# Altium schematic sheet ZYNQ_US_SOC_PL_FPGA_Banks_63_64_65_DDR4.SchDoc
size 419 x 296 mm
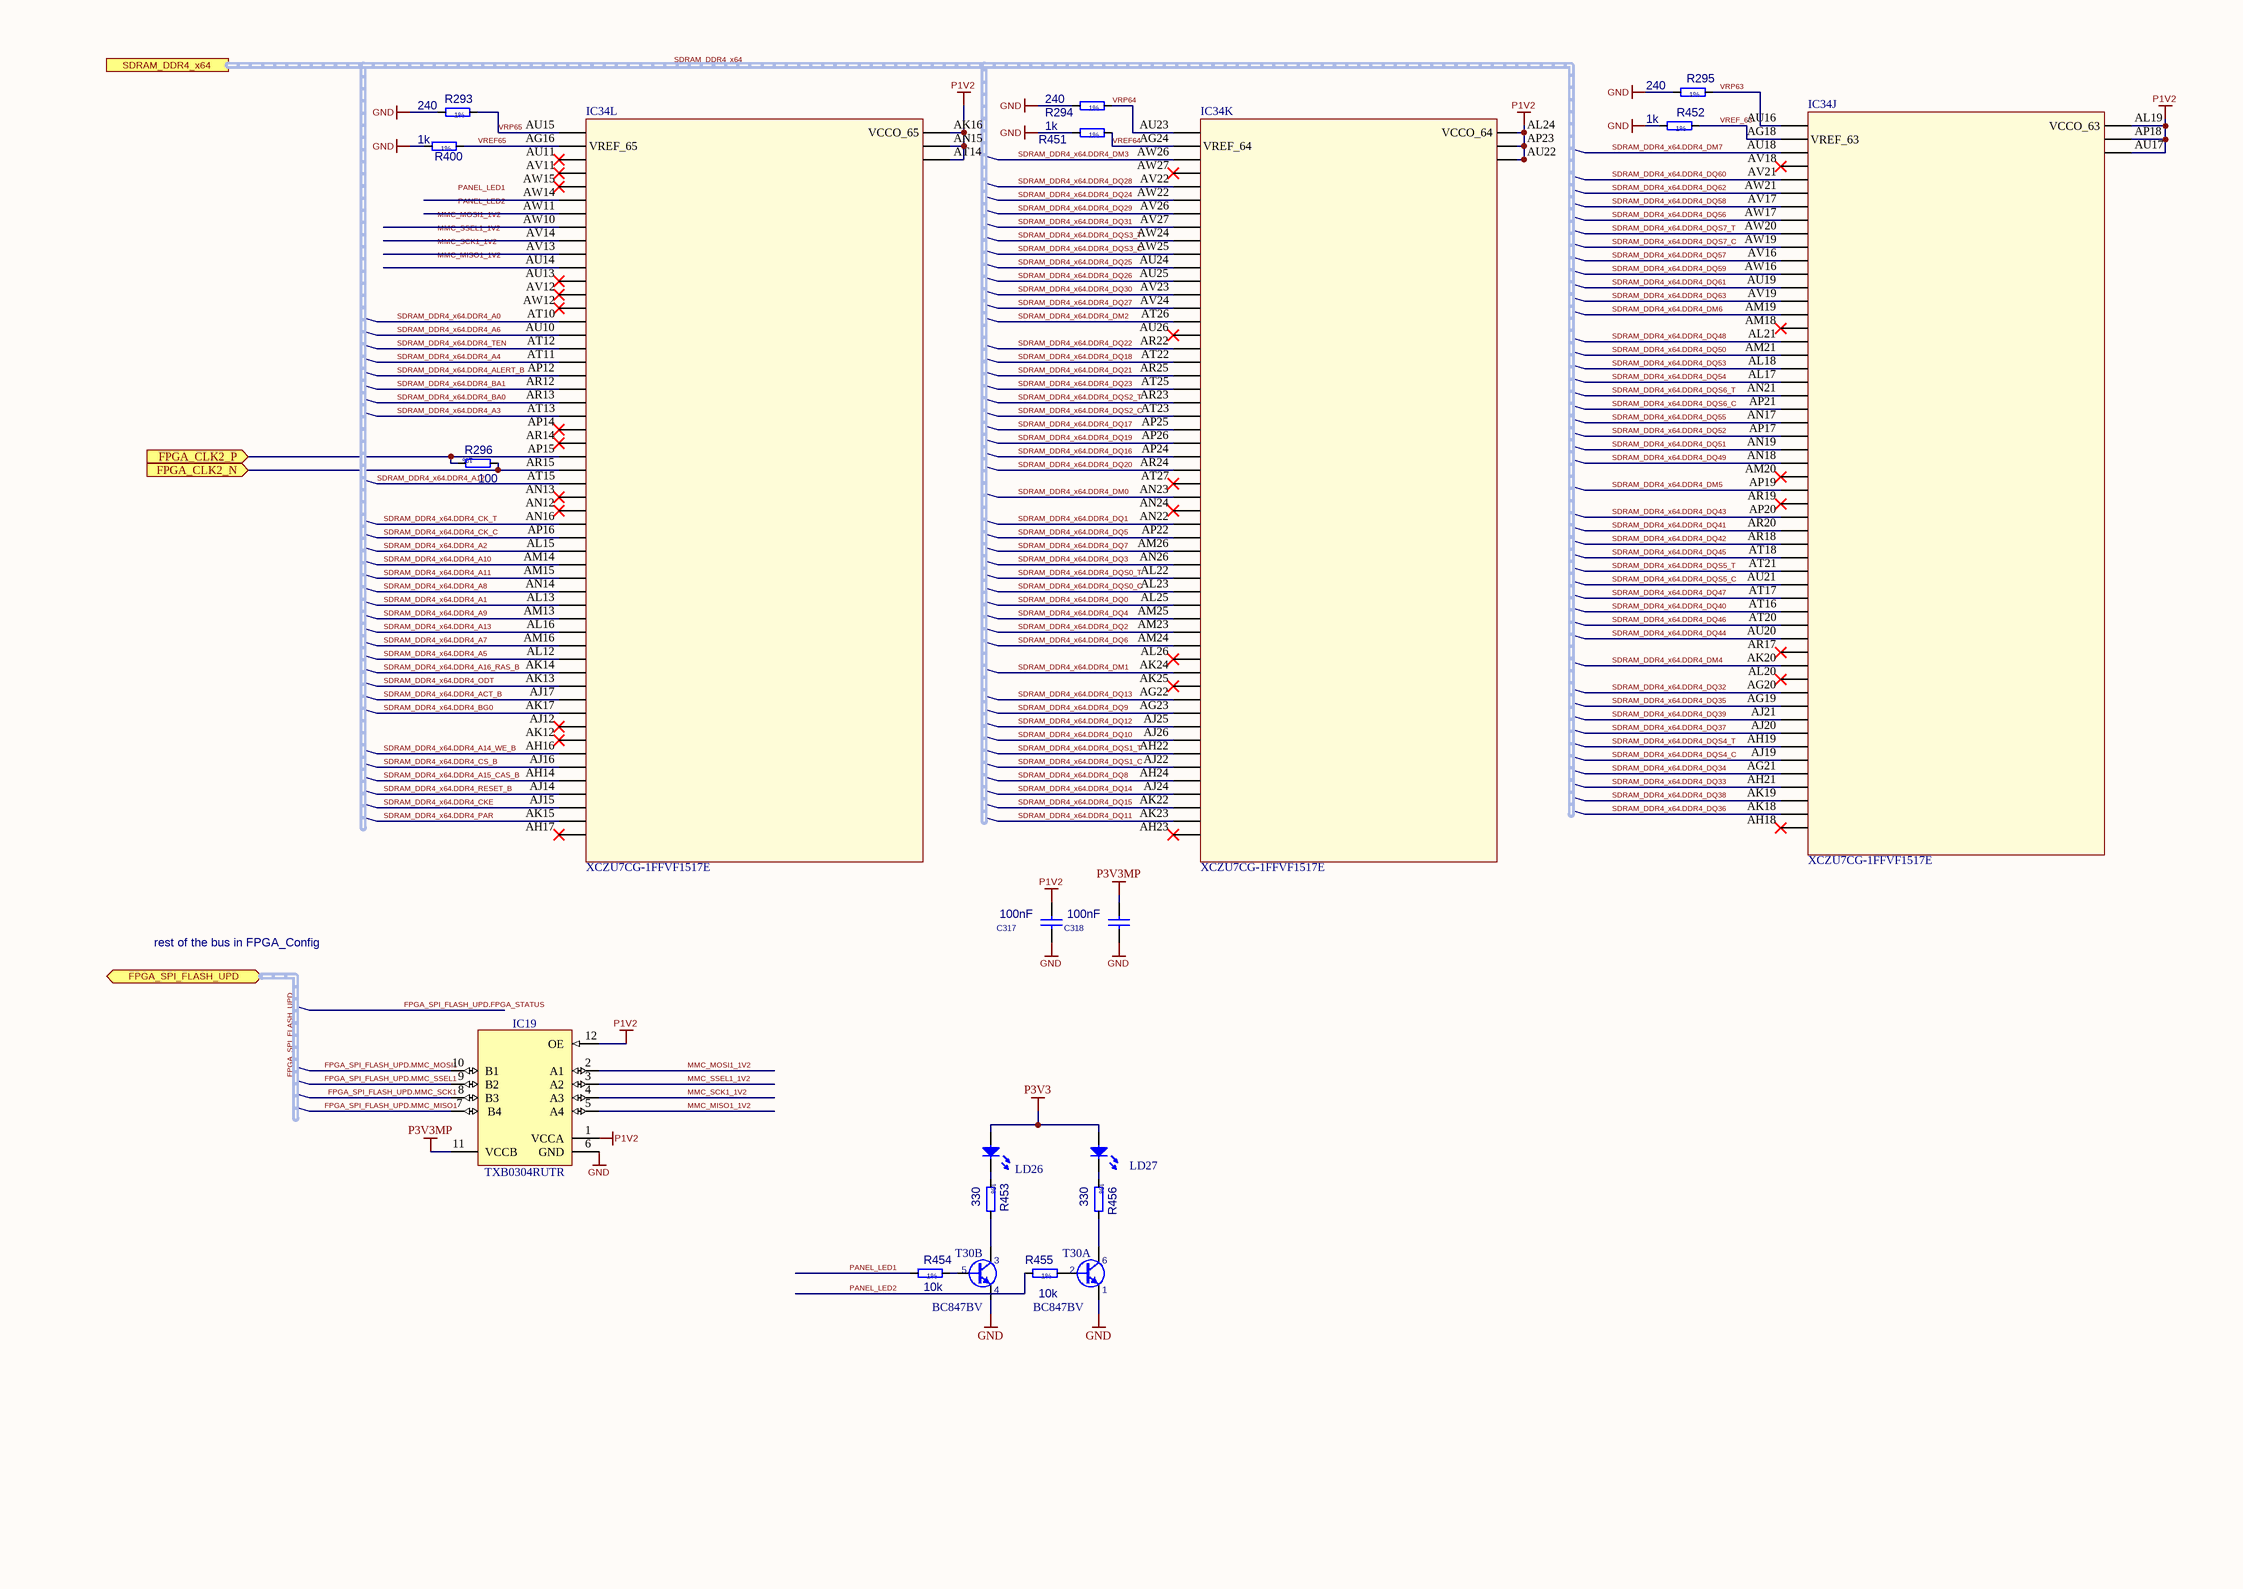
[diagram p0: ZYNQ_US_SOC_PL_FPGA_Banks_63_64_65_DDR4.SchDoc]

## Parts
C317  value 100nF  [CAPC0603X33N]  (hidden comment: Capacitor - non polarized CAPC0603X33N)
C318  value 100nF  [CAPC0603X33N]  (hidden comment: Capacitor - non polarized CAPC0603X33N)
IC19  TXB0304RUTR  [TEXAS_RUT (R-PUQFN-N12)]
IC34  XCZU7CG-1FFVF1517E  (parts J,K,L of 26)
LD26  Green  [LED_AVAGO_HSME-C120]  (value not drawn)
LD27  Green  [LED_AVAGO_HSME-C120]  (value not drawn)
R293  value 240  (hidden comment: Resistor - 1% RESC1005X40N)
R294  value 240  (hidden comment: Resistor - 1% RESC1005X40N)
R295  value 240  (hidden comment: Resistor - 1% RESC1005X40N)
R296  value 100  (hidden comment: Resistor - 1% RESC1005X40N)
R400  value 1k  (hidden comment: Resistor - 1% RESC1005X40N)
R451  value 1k  (hidden comment: Resistor - 1% RESC1005X40N)
R452  value 1k  (hidden comment: Resistor - 1% RESC1005X40N)
R453  value 330  (hidden comment: Resistor - 1% RESC1005X40N)
R454  value 10k  (hidden comment: Resistor - 1% RESC1005X40N)
R455  value 10k  (hidden comment: Resistor - 1% RESC1005X40N)
R456  value 330  (hidden comment: Resistor - 1% RESC1005X40N)
T30  BC847BV  [SOTFL50P160X60-6N]  (parts A,B of 2)

## Ports
FPGA_CLK2_N (in), FPGA_CLK2_P (in), FPGA_SPI_FLASH_UPD (bidir, harness FPGA_SPI_FLASH_UPD), SDRAM_DDR4_x64 (harness SDRAM_DDR4_x64)

## Nets
GND: C317.1 C318.1 IC19.6(GND) R293.1 R294.1 R295.1 R400.1 R451.1 R452.1 T30.1(E) T30.4(E)
P1V2: C317.2 IC19.1(VCCA) IC19.12(OE) IC34.AK16(VCCO_65) IC34.AL19(VCCO_63) IC34.AL24(VCCO_64) IC34.AN15(VCCO_65_1) IC34.AP18(VCCO_63_1) IC34.AP23(VCCO_64_1) IC34.AT14(VCCO_65_2) IC34.AU17(VCCO_63_2) IC34.AU22(VCCO_64_2)
P3V3: LD26.2(A) LD27.2(A)
P3V3MP: C318.2 IC19.11(VCCB)
FPGA_CLK2_N: IC34.AR15(IOB_X2Y128) R296.2 ; port FPGA_CLK2_N
FPGA_CLK2_P: IC34.AP15(IOB_X2Y127) R296.1 ; port FPGA_CLK2_P
FPGA_SPI_FLASH_UPD.MMC_MISO1: IC19.7(B4)
FPGA_SPI_FLASH_UPD.MMC_MOSI1: IC19.10(B1)
FPGA_SPI_FLASH_UPD.MMC_SCK1: IC19.8(B3)
FPGA_SPI_FLASH_UPD.MMC_SSEL1: IC19.9(B2)
MMC_MISO1_1V2: IC19.5(A4)
MMC_MOSI1_1V2: IC19.2(A1)
MMC_SCK1_1V2: IC19.4(A3)
MMC_SSEL1_1V2: IC19.3(A2)
PANEL_LED1: R454.1
PANEL_LED2: R455.1
SDRAM_DDR4_x64.DDR4_A0: IC34.AT10(IOB_X2Y117)
SDRAM_DDR4_x64.DDR4_A1: IC34.AL13(IOB_X2Y138)
SDRAM_DDR4_x64.DDR4_A2: IC34.AL15(IOB_X2Y134)
SDRAM_DDR4_x64.DDR4_A3: IC34.AT13(IOB_X2Y124)
SDRAM_DDR4_x64.DDR4_A4: IC34.AT11(IOB_X2Y120)
SDRAM_DDR4_x64.DDR4_A5: IC34.AL12(IOB_X2Y142)
SDRAM_DDR4_x64.DDR4_A6: IC34.AU10(IOB_X2Y118)
SDRAM_DDR4_x64.DDR4_A7: IC34.AM16(IOB_X2Y141)
SDRAM_DDR4_x64.DDR4_A8: IC34.AN14(IOB_X2Y137)
SDRAM_DDR4_x64.DDR4_A9: IC34.AM13(IOB_X2Y139)
SDRAM_DDR4_x64.DDR4_A10: IC34.AM14(IOB_X2Y135)
SDRAM_DDR4_x64.DDR4_A11: IC34.AM15(IOB_X2Y136)
SDRAM_DDR4_x64.DDR4_A12: IC34.AT15(IOB_X2Y129)
SDRAM_DDR4_x64.DDR4_A13: IC34.AL16(IOB_X2Y140)
SDRAM_DDR4_x64.DDR4_A14_WE_B: IC34.AH16(IOB_X2Y149)
SDRAM_DDR4_x64.DDR4_A15_CAS_B: IC34.AH14(IOB_X2Y151)
SDRAM_DDR4_x64.DDR4_A16_RAS_B: IC34.AK14(IOB_X2Y143)
SDRAM_DDR4_x64.DDR4_ACT_B: IC34.AJ17(IOB_X2Y145)
SDRAM_DDR4_x64.DDR4_ALERT_B: IC34.AP12(IOB_X2Y121)
SDRAM_DDR4_x64.DDR4_BA0: IC34.AR13(IOB_X2Y123)
SDRAM_DDR4_x64.DDR4_BA1: IC34.AR12(IOB_X2Y122)
SDRAM_DDR4_x64.DDR4_BG0: IC34.AK17(IOB_X2Y146)
SDRAM_DDR4_x64.DDR4_CK_C: IC34.AP16(IOB_X2Y133)
SDRAM_DDR4_x64.DDR4_CK_T: IC34.AN16(IOB_X2Y132)
SDRAM_DDR4_x64.DDR4_CKE: IC34.AJ15(IOB_X2Y153)
SDRAM_DDR4_x64.DDR4_CS_B: IC34.AJ16(IOB_X2Y150)
SDRAM_DDR4_x64.DDR4_DM0: IC34.AN23(IOB_X2Y78)
SDRAM_DDR4_x64.DDR4_DM1: IC34.AK24(IOB_X2Y91)
SDRAM_DDR4_x64.DDR4_DM2: IC34.AT26(IOB_X2Y65)
SDRAM_DDR4_x64.DDR4_DM3: IC34.AW26(IOB_X2Y52)
SDRAM_DDR4_x64.DDR4_DM4: IC34.AK20(IOB_X2Y39)
SDRAM_DDR4_x64.DDR4_DM5: IC34.AP19(IOB_X2Y26)
SDRAM_DDR4_x64.DDR4_DM6: IC34.AM19(IOB_X2Y13)
SDRAM_DDR4_x64.DDR4_DM7: IC34.AU18(IOB_X2Y0)
SDRAM_DDR4_x64.DDR4_DQ0: IC34.AL25(IOB_X2Y86)
SDRAM_DDR4_x64.DDR4_DQ1: IC34.AN22(IOB_X2Y80)
SDRAM_DDR4_x64.DDR4_DQ2: IC34.AM23(IOB_X2Y88)
SDRAM_DDR4_x64.DDR4_DQ3: IC34.AN26(IOB_X2Y83)
SDRAM_DDR4_x64.DDR4_DQ4: IC34.AM25(IOB_X2Y87)
SDRAM_DDR4_x64.DDR4_DQ5: IC34.AP22(IOB_X2Y81)
SDRAM_DDR4_x64.DDR4_DQ6: IC34.AM24(IOB_X2Y89)
SDRAM_DDR4_x64.DDR4_DQ7: IC34.AM26(IOB_X2Y82)
SDRAM_DDR4_x64.DDR4_DQ8: IC34.AH24(IOB_X2Y99)
SDRAM_DDR4_x64.DDR4_DQ9: IC34.AG23(IOB_X2Y94)
SDRAM_DDR4_x64.DDR4_DQ10: IC34.AJ26(IOB_X2Y96)
SDRAM_DDR4_x64.DDR4_DQ11: IC34.AK23(IOB_X2Y102)
SDRAM_DDR4_x64.DDR4_DQ12: IC34.AJ25(IOB_X2Y95)
SDRAM_DDR4_x64.DDR4_DQ13: IC34.AG22(IOB_X2Y93)
SDRAM_DDR4_x64.DDR4_DQ14: IC34.AJ24(IOB_X2Y100)
SDRAM_DDR4_x64.DDR4_DQ15: IC34.AK22(IOB_X2Y101)
SDRAM_DDR4_x64.DDR4_DQ16: IC34.AP24(IOB_X2Y75)
SDRAM_DDR4_x64.DDR4_DQ17: IC34.AP25(IOB_X2Y73)
SDRAM_DDR4_x64.DDR4_DQ18: IC34.AT22(IOB_X2Y68)
SDRAM_DDR4_x64.DDR4_DQ19: IC34.AP26(IOB_X2Y74)
SDRAM_DDR4_x64.DDR4_DQ20: IC34.AR24(IOB_X2Y76)
SDRAM_DDR4_x64.DDR4_DQ21: IC34.AR25(IOB_X2Y69)
SDRAM_DDR4_x64.DDR4_DQ22: IC34.AR22(IOB_X2Y67)
SDRAM_DDR4_x64.DDR4_DQ23: IC34.AT25(IOB_X2Y70)
SDRAM_DDR4_x64.DDR4_DQ24: IC34.AW22(IOB_X2Y55)
SDRAM_DDR4_x64.DDR4_DQ25: IC34.AU24(IOB_X2Y60)
SDRAM_DDR4_x64.DDR4_DQ26: IC34.AU25(IOB_X2Y61)
SDRAM_DDR4_x64.DDR4_DQ27: IC34.AV24(IOB_X2Y63)
SDRAM_DDR4_x64.DDR4_DQ28: IC34.AV22(IOB_X2Y54)
SDRAM_DDR4_x64.DDR4_DQ29: IC34.AV26(IOB_X2Y56)
SDRAM_DDR4_x64.DDR4_DQ30: IC34.AV23(IOB_X2Y62)
SDRAM_DDR4_x64.DDR4_DQ31: IC34.AV27(IOB_X2Y57)
SDRAM_DDR4_x64.DDR4_DQ32: IC34.AG20(IOB_X2Y41)
SDRAM_DDR4_x64.DDR4_DQ33: IC34.AH21(IOB_X2Y48)
SDRAM_DDR4_x64.DDR4_DQ34: IC34.AG21(IOB_X2Y47)
SDRAM_DDR4_x64.DDR4_DQ35: IC34.AG19(IOB_X2Y42)
SDRAM_DDR4_x64.DDR4_DQ36: IC34.AK18(IOB_X2Y50)
SDRAM_DDR4_x64.DDR4_DQ37: IC34.AJ20(IOB_X2Y44)
SDRAM_DDR4_x64.DDR4_DQ38: IC34.AK19(IOB_X2Y49)
SDRAM_DDR4_x64.DDR4_DQ39: IC34.AJ21(IOB_X2Y43)
SDRAM_DDR4_x64.DDR4_DQ40: IC34.AT16(IOB_X2Y35)
SDRAM_DDR4_x64.DDR4_DQ41: IC34.AR20(IOB_X2Y29)
SDRAM_DDR4_x64.DDR4_DQ42: IC34.AR18(IOB_X2Y30)
SDRAM_DDR4_x64.DDR4_DQ43: IC34.AP20(IOB_X2Y28)
SDRAM_DDR4_x64.DDR4_DQ44: IC34.AU20(IOB_X2Y37)
SDRAM_DDR4_x64.DDR4_DQ45: IC34.AT18(IOB_X2Y31)
SDRAM_DDR4_x64.DDR4_DQ46: IC34.AT20(IOB_X2Y36)
SDRAM_DDR4_x64.DDR4_DQ47: IC34.AT17(IOB_X2Y34)
SDRAM_DDR4_x64.DDR4_DQ48: IC34.AL21(IOB_X2Y15)
SDRAM_DDR4_x64.DDR4_DQ49: IC34.AN18(IOB_X2Y24)
SDRAM_DDR4_x64.DDR4_DQ50: IC34.AM21(IOB_X2Y16)
SDRAM_DDR4_x64.DDR4_DQ51: IC34.AN19(IOB_X2Y23)
SDRAM_DDR4_x64.DDR4_DQ52: IC34.AP17(IOB_X2Y22)
SDRAM_DDR4_x64.DDR4_DQ53: IC34.AL18(IOB_X2Y17)
SDRAM_DDR4_x64.DDR4_DQ54: IC34.AL17(IOB_X2Y18)
SDRAM_DDR4_x64.DDR4_DQ55: IC34.AN17(IOB_X2Y21)
SDRAM_DDR4_x64.DDR4_DQ56: IC34.AW17(IOB_X2Y5)
SDRAM_DDR4_x64.DDR4_DQ57: IC34.AV16(IOB_X2Y8)
SDRAM_DDR4_x64.DDR4_DQ58: IC34.AV17(IOB_X2Y4)
SDRAM_DDR4_x64.DDR4_DQ59: IC34.AW16(IOB_X2Y9)
SDRAM_DDR4_x64.DDR4_DQ60: IC34.AV21(IOB_X2Y2)
SDRAM_DDR4_x64.DDR4_DQ61: IC34.AU19(IOB_X2Y10)
SDRAM_DDR4_x64.DDR4_DQ62: IC34.AW21(IOB_X2Y3)
SDRAM_DDR4_x64.DDR4_DQ63: IC34.AV19(IOB_X2Y11)
SDRAM_DDR4_x64.DDR4_DQS0_C: IC34.AL23(IOB_X2Y85)
SDRAM_DDR4_x64.DDR4_DQS0_T: IC34.AL22(IOB_X2Y84)
SDRAM_DDR4_x64.DDR4_DQS1_C: IC34.AJ22(IOB_X2Y98)
SDRAM_DDR4_x64.DDR4_DQS1_T: IC34.AH22(IOB_X2Y97)
SDRAM_DDR4_x64.DDR4_DQS2_C: IC34.AT23(IOB_X2Y72)
SDRAM_DDR4_x64.DDR4_DQS2_T: IC34.AR23(IOB_X2Y71)
SDRAM_DDR4_x64.DDR4_DQS3_C: IC34.AW25(IOB_X2Y59)
SDRAM_DDR4_x64.DDR4_DQS3_T: IC34.AW24(IOB_X2Y58)
SDRAM_DDR4_x64.DDR4_DQS4_C: IC34.AJ19(IOB_X2Y46)
SDRAM_DDR4_x64.DDR4_DQS4_T: IC34.AH19(IOB_X2Y45)
SDRAM_DDR4_x64.DDR4_DQS5_C: IC34.AU21(IOB_X2Y33)
SDRAM_DDR4_x64.DDR4_DQS5_T: IC34.AT21(IOB_X2Y32)
SDRAM_DDR4_x64.DDR4_DQS6_C: IC34.AP21(IOB_X2Y20)
SDRAM_DDR4_x64.DDR4_DQS6_T: IC34.AN21(IOB_X2Y19)
SDRAM_DDR4_x64.DDR4_DQS7_C: IC34.AW19(IOB_X2Y7)
SDRAM_DDR4_x64.DDR4_DQS7_T: IC34.AW20(IOB_X2Y6)
SDRAM_DDR4_x64.DDR4_ODT: IC34.AK13(IOB_X2Y144)
SDRAM_DDR4_x64.DDR4_PAR: IC34.AK15(IOB_X2Y154)
SDRAM_DDR4_x64.DDR4_RESET_B: IC34.AJ14(IOB_X2Y152)
SDRAM_DDR4_x64.DDR4_TEN: IC34.AT12(IOB_X2Y119)
VREF64: IC34.AG24(VREF_64) R451.2
VREF65: IC34.AG16(VREF_65) R400.2
VREF_63: IC34.AG18(VREF_63) R452.2
VRP63: IC34.AU16(IOB_X2Y12) R295.2
VRP64: IC34.AU23(IOB_X2Y64) R294.2
VRP65: IC34.AU15(IOB_X2Y116) R293.2
NetLD26_1: LD26.1(C) R453.1
NetLD27_1: LD27.1(C) R456.1
NetR453_2: R453.2 T30.3(C)
NetR454_2: R454.2 T30.5(B)
NetR455_2: R455.2 T30.2(B)
NetR456_2: R456.2 T30.6(C)

Not connected (* = marked no-connect by the designer): IC34 AH17(IOB_X2Y155)* AH18(IOB_X2Y51)* AH23(IOB_X2Y103)* AJ12(IOB_X2Y147)* AK12(IOB_X2Y148)* AK25(IOB_X2Y92)* AL20(IOB_X2Y40)* AL26(IOB_X2Y90)* AM18(IOB_X2Y14)* AM20(IOB_X2Y25)* AN12(IOB_X2Y131)* AN13(IOB_X2Y130)* AN24(IOB_X2Y79)* AP14(IOB_X2Y125)* AR14(IOB_X2Y126)* AR17(IOB_X2Y38)* AR19(IOB_X2Y27)* AT27(IOB_X2Y77)* AU11(IOB_X2Y104)* AU13(IOB_X2Y113)* AU14(IOB_X2Y112) AU26(IOB_X2Y66)* AV11(IOB_X2Y105)* AV12(IOB_X2Y114)* AV13(IOB_X2Y111) AV14(IOB_X2Y110) AV18(IOB_X2Y1)* AW10(IOB_X2Y109) AW11(IOB_X2Y108) AW12(IOB_X2Y115)* AW14(IOB_X2Y107) AW15(IOB_X2Y106)* AW27(IOB_X2Y53)*

## Buses and harness runs
harness FPGA_SPI_FLASH_UPD = port FPGA_SPI_FLASH_UPD
harness SDRAM_DDR4_x64 = port SDRAM_DDR4_x64

## Notes on the sheet
- rest of the bus in FPGA_Config
- Labels drawn without touching a wire or pin: MMC_MISO1_1V2, MMC_MOSI1_1V2, MMC_SCK1_1V2, MMC_SSEL1_1V2, PANEL_LED1, PANEL_LED2
- (in symbol R293) 1%
- (in symbol R294) 1%
- (in symbol R295) 1%
- (in symbol R296) 1%
- (in symbol R400) 1%
- (in symbol R451) 1%
- (in symbol R452) 1%
- (in symbol R453) 1%
- (in symbol R454) 1%
- (in symbol R455) 1%
- (in symbol R456) 1%

## Library data of the parts
C317 = CAPC0603X33N: Capacitor - non polarized CAPC0603X33N 100nF; Manufacturer Part Number: CC0201_100NF_6.3V_10%_X5R; Manufacturer: GENERIC; Part Description: SMD Multilayer Chip Ceramic Capacitor; CmpIndex: 614; DXDB_LIBNAME: Capacitors SMD; Ref Designator: C317; SymIndex: 331; Tolerance: ±10%; Cell Name: CAPC0603X33N; Part Name: Capacitor - non polarized CAPC0603X33N; Part Number: Capacitor - non polarized CAPC0603X33N; Orientation: 1 = 1
C318 = CAPC0603X33N: Capacitor - non polarized CAPC0603X33N 100nF; Manufacturer Part Number: CC0201_100NF_6.3V_10%_X5R; Manufacturer: GENERIC; Part Description: SMD Multilayer Chip Ceramic Capacitor; CmpIndex: 610; DXDB_LIBNAME: Capacitors SMD; Ref Designator: C318; SymIndex: 331; Tolerance: ±10%; Cell Name: CAPC0603X33N; Part Name: Capacitor - non polarized CAPC0603X33N; Part Number: Capacitor - non polarized CAPC0603X33N; Orientation: 1 = 1
IC19 = TXB0304RUTR: 4-bit Bidirectional Auto-direction Sensing Translator with Fully Symmetric 0.9V to 3.6V Range; Manufacturer: TEXAS INSTRUMENTS; PressFit: No; Bonding: No; Manufacturer Part Number: TXB0304RUTR; PackageDescription: SON, TEXAS RUT (R-PUQFN-N12), 0.50mm Pitch, 12-pin, 1.70mm W  X 2.00mm L X 0.55mm Height; Part Description: 4-bit Bidirectional Auto-direction Sensing Translator with Fully Symmetric 0.9V to 3.6V Range; Part Number: TXB0304RUTR; Component Kind: Standard; Component Type: Standard; Device: TXB0304RUTR; Pin Count: 12; Case: QFN12; Mounted: Yes; Socket: No; SMD: Yes; Sense: No; ComponentHeight: 0.55mm; Author: CERN DEM JLC; HelpURL: \\cern.ch\dfs\Applications\Altium\Datasheets\TXB0304RUTR.pdf; CreateDate: 27.10.2014; LatestRevisionDate: 28.10.2014
LD26 LD27 = LED_AVAGO_HSME-C120: LED Green 1C 2A; Manufacturer: AVAGO TECHNOLOGIES; Part Description: High Performance Right Angle Chip Green LED; PressFit: No; Bonding: No; Manufacturer Part Number: HSME-C120; PackageDescription: Green Chip LED, 2-Leads, Body 1.7x1.1mm, Side Emitting Package; Part Number: LED_AVAGO_HSME-C120; Component Kind: Standard; Component Type: Standard; Color: Green; Pin Count: 2; Mounted: Yes; Socket: No; SMD: Yes; Sense: No; ComponentHeight: 0.7mm; HelpURL: \\cern.ch\dfs\Applications\Altium\Datasheets\LED_AVAGO_HSME-C120.pdf; ComponentLink1URL: \\cern.ch\dfs\Applications\Altium\Datasheets\LED_AVAGO_HSME-C110_DESIGN-GUIDE.pdf; ComponentLink1Description: Design Guide; Author: CERN DEM JMW; CreateDate: 22.07.2009; LatestRevisionDate: 20.06.2012
R293 = (no symbol name): Resistor - 1% RESC1005X40N 240; Manufacturer Part Number: R0402_240R_1%_0.0625W_100PPM; Manufacturer: GENERIC; Part Description: General Purpose Thick Film Chip Resistor; CmpIndex: 232; DXDB_LIBNAME: Resistors SMD; Ref Designator: R293; SymIndex: 317; Cell Name: RESC1005X40N; Part Name: Resistor - 1% RESC1005X40N; Part Number: Resistor - 1% RESC1005X40N; Tolerance: ±1%; Orientation: 0 = 0
R294 = (no symbol name): Resistor - 1% RESC1005X40N 240; Manufacturer Part Number: R0402_240R_1%_0.0625W_100PPM; Manufacturer: GENERIC; Part Description: General Purpose Thick Film Chip Resistor; CmpIndex: 235; DXDB_LIBNAME: Resistors SMD; Ref Designator: R294; SymIndex: 317; Cell Name: RESC1005X40N; Part Name: Resistor - 1% RESC1005X40N; Part Number: Resistor - 1% RESC1005X40N; Tolerance: ±1%; Orientation: 0 = 0
R295 = (no symbol name): Resistor - 1% RESC1005X40N 240; Manufacturer Part Number: R0402_240R_1%_0.0625W_100PPM; Manufacturer: GENERIC; Part Description: General Purpose Thick Film Chip Resistor; CmpIndex: 237; DXDB_LIBNAME: Resistors SMD; Ref Designator: R295; SymIndex: 317; Cell Name: RESC1005X40N; Part Name: Resistor - 1% RESC1005X40N; Part Number: Resistor - 1% RESC1005X40N; Tolerance: ±1%; Orientation: 0 = 0
R296 = (no symbol name): Manufacturer Part Number: R0402_100R_1%_0.0625W_100PPM; Manufacturer: GENERIC; Part Description: General Purpose Thick Film Chip Resistor; CmpIndex: 24; DXDB_LIBNAME: Resistors SMD; Ref Designator: R296; SymIndex: 317; Cell Name: RESC1005X40N; Part Name: Resistor - 1% RESC1005X40N; Part Number: Resistor - 1% RESC1005X40N; Tolerance: ±1%; Orientation: 6 = 6
R400 = (no symbol name): Resistor - 1% RESC1005X40N 1k; Manufacturer Part Number: R0402_1K_1%_0.0625W_100PPM; Manufacturer: GENERIC; Part Description: General Purpose Thick Film Chip Resistor; CmpIndex: 535; DXDB_LIBNAME: Resistors SMD; Ref Designator: R400; SymIndex: 317; Cell Name: RESC1005X40N; Part Name: Resistor - 1% RESC1005X40N; Part Number: Resistor - 1% RESC1005X40N; Tolerance: ±1%; Orientation: 0 = 0
R451 = (no symbol name): Resistor - 1% RESC1005X40N 1k; Manufacturer Part Number: R0402_1K_1%_0.0625W_100PPM; Manufacturer: GENERIC; Part Description: General Purpose Thick Film Chip Resistor; CmpIndex: 538; DXDB_LIBNAME: Resistors SMD; Ref Designator: R451; SymIndex: 317; Cell Name: RESC1005X40N; Part Name: Resistor - 1% RESC1005X40N; Part Number: Resistor - 1% RESC1005X40N; Tolerance: ±1%; Orientation: 0 = 0
R452 = (no symbol name): Resistor - 1% RESC1005X40N 1k; Manufacturer Part Number: R0402_1K_1%_0.0625W_100PPM; Manufacturer: GENERIC; Part Description: General Purpose Thick Film Chip Resistor; CmpIndex: 62; DXDB_LIBNAME: Resistors SMD; Ref Designator: R452; SymIndex: 317; Cell Name: RESC1005X40N; Part Name: Resistor - 1% RESC1005X40N; Part Number: Resistor - 1% RESC1005X40N; Tolerance: ±1%; Orientation: 0 = 0
R453 = (no symbol name): Resistor - 1% RESC1005X40N 330; Manufacturer Part Number: R0402_330R_1%_0.0625W_100PPM; Manufacturer: GENERIC; Part Description: General Purpose Thick Film Chip Resistor; CmpIndex: 675; DXDB_LIBNAME: Resistors SMD; Ref Designator: R453; SymIndex: 317; Cell Name: RESC1005X40N; Part Name: Resistor - 1% RESC1005X40N; Part Number: Resistor - 1% RESC1005X40N; Tolerance: ±1%; Orientation: 5 = 5
R454 = (no symbol name): Resistor - 1% RESC1005X40N 10k; Manufacturer Part Number: R0402_10K_1%_0.0625W_100PPM; Manufacturer: GENERIC; Part Description: General Purpose Thick Film Chip Resistor; CmpIndex: 684; DXDB_LIBNAME: Resistors SMD; Ref Designator: R454; SymIndex: 317; Cell Name: RESC1005X40N; Part Name: Resistor - 1% RESC1005X40N; Part Number: Resistor - 1% RESC1005X40N; Tolerance: ±1%; Orientation: 0 = 0
R455 = (no symbol name): Resistor - 1% RESC1005X40N 10k; Manufacturer Part Number: R0402_10K_1%_0.0625W_100PPM; Manufacturer: GENERIC; Part Description: General Purpose Thick Film Chip Resistor; CmpIndex: 688; DXDB_LIBNAME: Resistors SMD; Ref Designator: R455; SymIndex: 317; Cell Name: RESC1005X40N; Part Name: Resistor - 1% RESC1005X40N; Part Number: Resistor - 1% RESC1005X40N; Tolerance: ±1%; Orientation: 0 = 0
R456 = (no symbol name): Resistor - 1% RESC1005X40N 330; Manufacturer Part Number: R0402_330R_1%_0.0625W_100PPM; Manufacturer: GENERIC; Part Description: General Purpose Thick Film Chip Resistor; CmpIndex: 677; DXDB_LIBNAME: Resistors SMD; Ref Designator: R456; SymIndex: 317; Cell Name: RESC1005X40N; Part Name: Resistor - 1% RESC1005X40N; Part Number: Resistor - 1% RESC1005X40N; Tolerance: ±1%; Orientation: 5 = 5
T30 = BC847BV: 45V, 100mA NPN General Purpose Double Transistor; Manufacturer: NXP SEMICONDUCTORS; Part Description: 45V 100mA NPN General Purpose Double Transistor; PressFit: No; Bonding: No; Manufacturer Part Number: BC847BV; PackageDescription: SOTFL (SOT666), 0.50mm, Pitch; 6 Pin, 1.20mm W X 1.60mm L X 0.60mm H Body, IPC Medium Density; Part Number: BC847BV; Component Kind: Standard; Component Type: Standard; Device: BC847BV; Pin Count: 6; Case: SOT666; Mounted: Yes; Socket: No; SMD: Yes; Sense: No; ComponentHeight: 0.6mm; HelpURL: \\cern.ch\dfs\Applications\Altium\Datasheets\BC847BV.pdf; Author: CERN DEM JLC; CreateDate: 01.12.2011; LatestRevisionDate: 01.12.2011